# EasyEDA Pro project rckid3_devboard.eprj, board RCKid (continued)
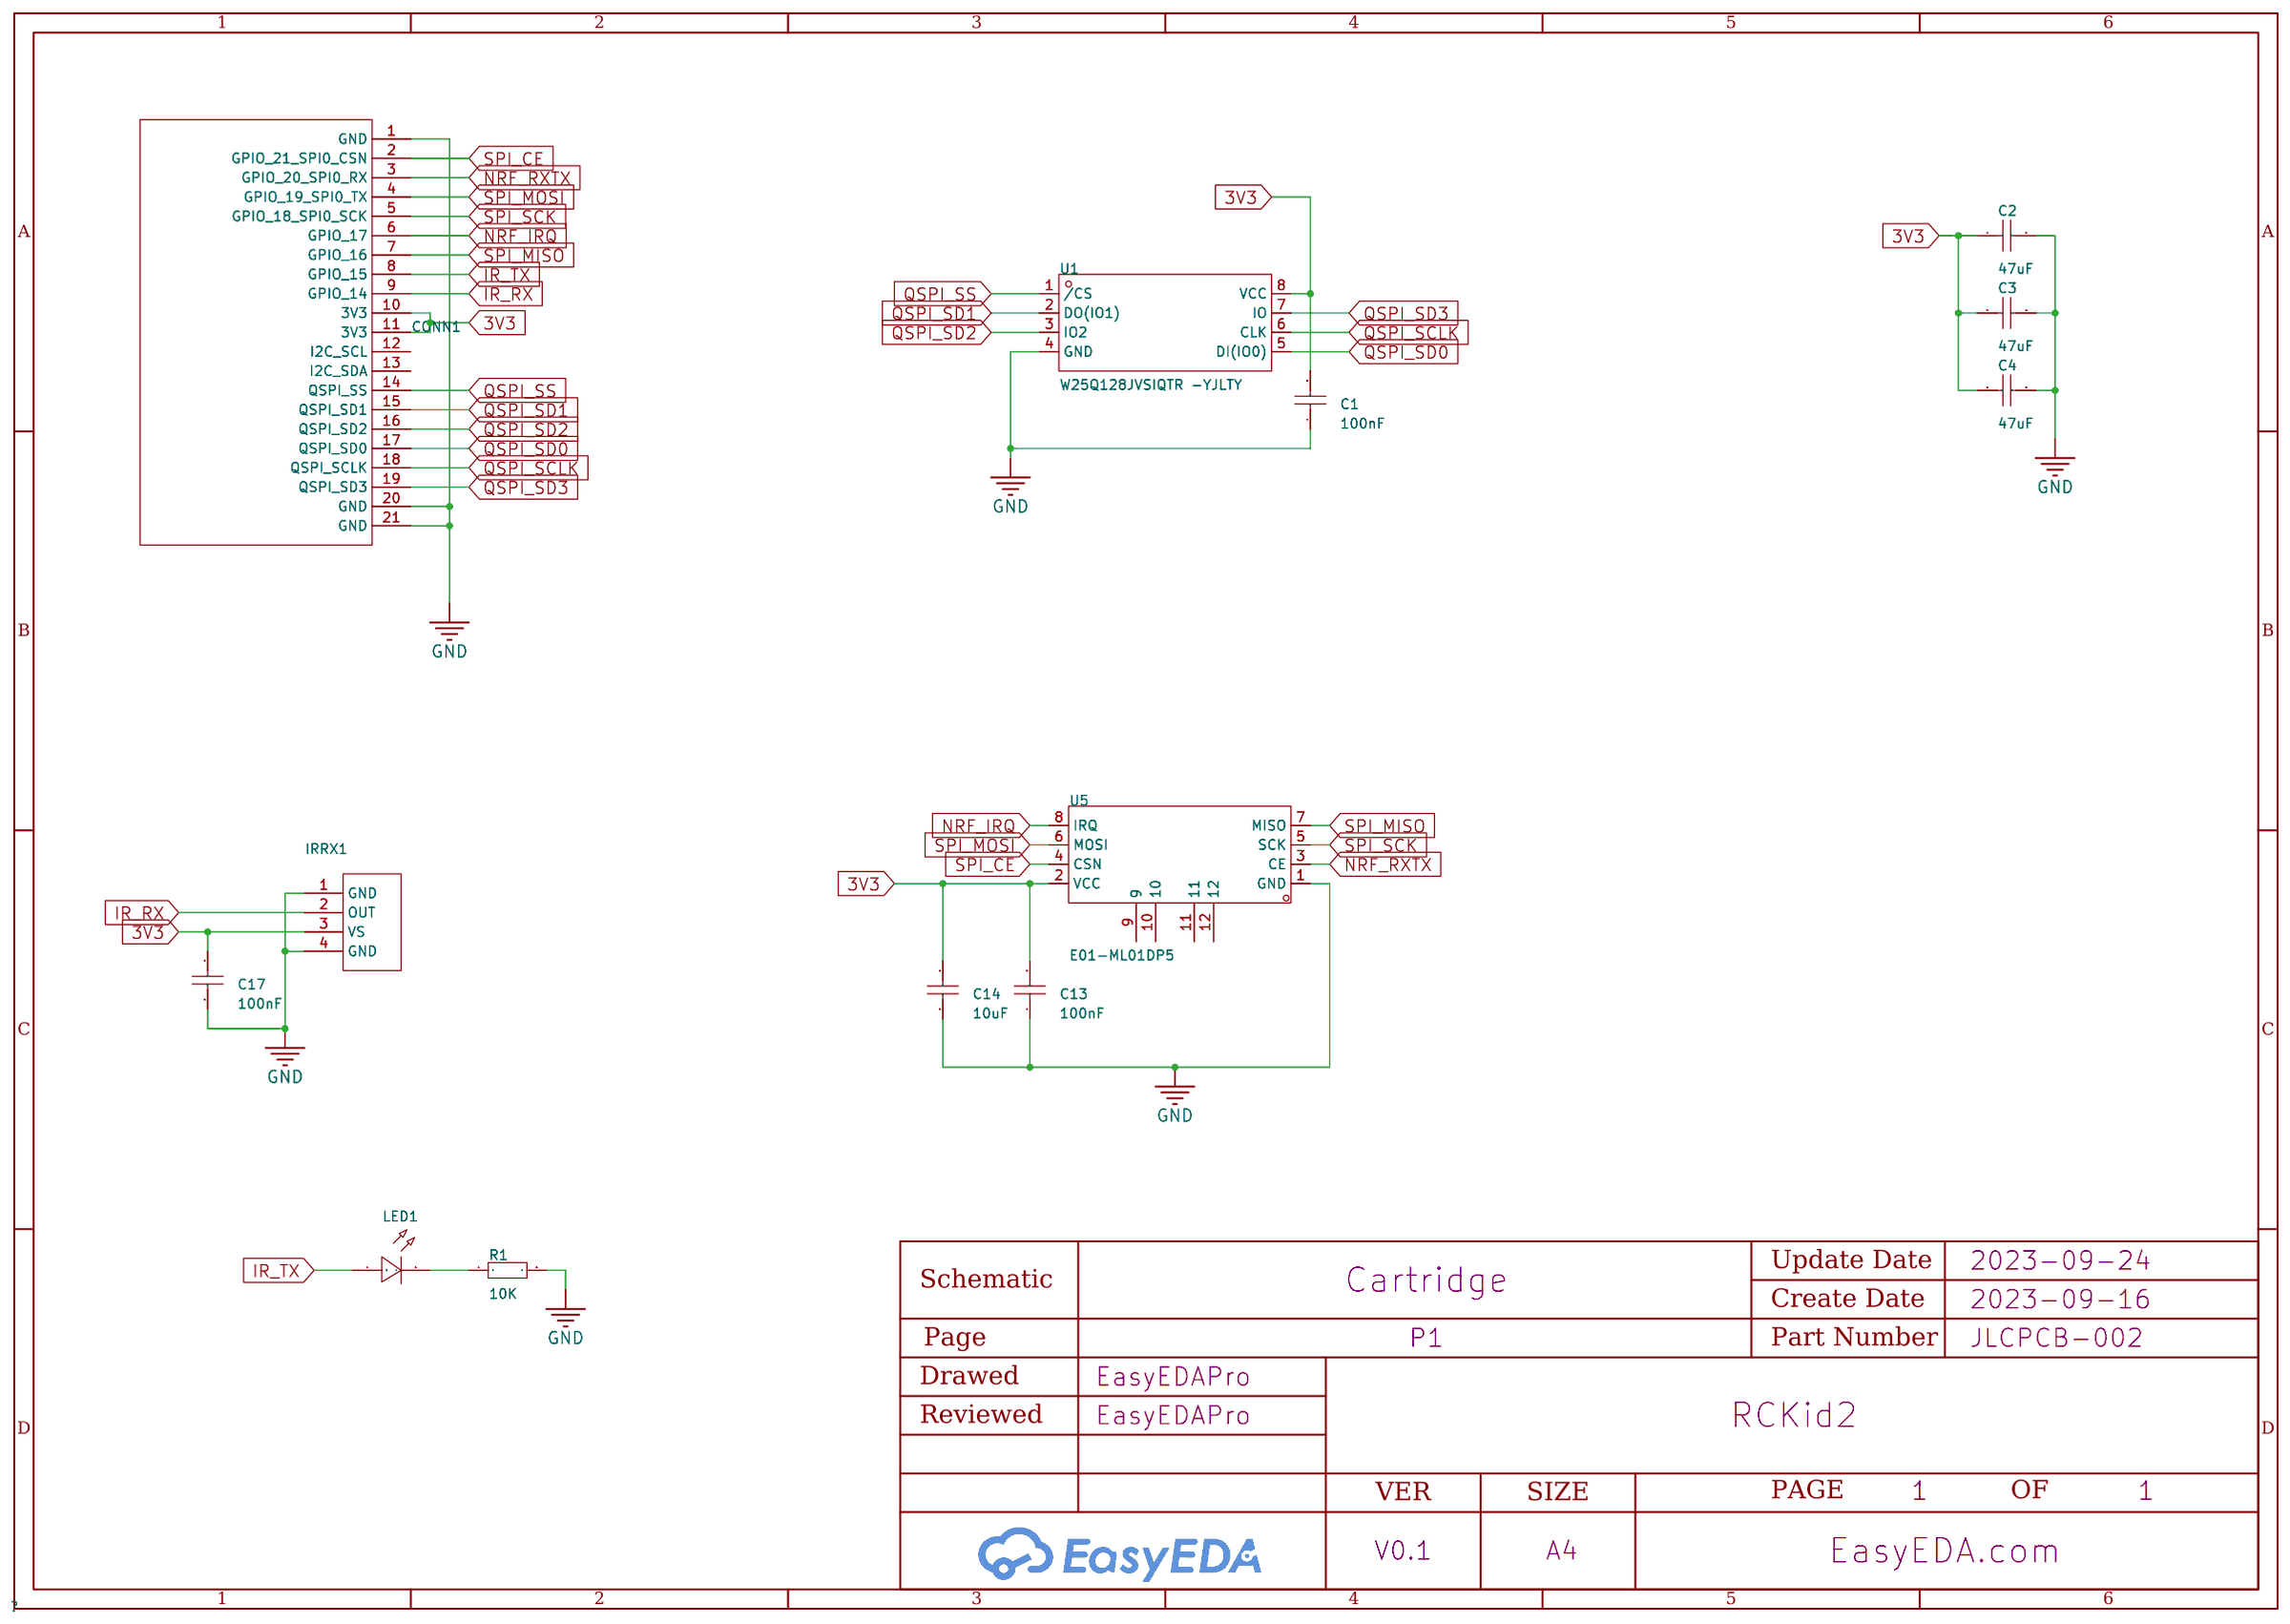
[diagram p0: NRF24L01P]
## Routing (per net, layer and track width the routed paths; a pad name or vN(x,y) marks a point on that pad's centre or on a via; arc(x,y) is an arc through that point) (continued)
  Bottom Layer w0.2: v1(82,57.19) HOME1.1
BTN_DPAD: length 44.7
  Top Layer w0.15: v1(41.4,49.29) 42,49.89 46.2,49.89 46.65,49.44 AVR.19 ; LEFT1.2 LEFT1.4
  Top Layer w0.2: LEFT1.4 32.7,46.44 34.65,44.49 BOTTOM1.2 BOTTOM1.4 34.65,38.49 32.7,36.54 RIGHT1.2 ; RIGHT1.4 26.7,36.54 24.75,38.49 TOP1.2 TOP1.4 24.75,44.49 26.7,46.44 LEFT1.2
  Bottom Layer w0.15: v1(41.4,49.29) 37.6,45.49 v1(33.7,45.49)
DB_0: length 60.7
  Top Layer w0.15: DISPLAY.24 59.77,82.79 58.8,82.79 46.5,95.09 37.5,95.09 35.6,96.99 25.6,96.99 23.2,94.59 23.2,87.99 21.3,86.09 21.3,82.56 22.27,81.59 RP2350B.44
DB_1: length 59.3
  Top Layer w0.15: DISPLAY.23 58.55,82.24 46.3,94.49 37.3,94.49 35.2,96.59 26,96.59 23.8,94.39 23.8,87.79 21.7,85.69 21.7,82.72 22.43,81.99 RP2350B.43
DB_2: length 57.9
  Top Layer w0.15: DISPLAY.22 58.25,81.74 46.1,93.89 37.1,93.89 34.8,96.19 26.4,96.19 24.4,94.19 24.4,87.59 22.1,85.29 22.1,82.89 22.6,82.39 RP2350B.42
DB_3: length 52.3
  Top Layer w0.15: RP2350B.40 26.4,84.39 25,85.79 25,93.99 26.8,95.79 34.4,95.79 36.9,93.29 45.9,93.29 57.95,81.24 DISPLAY.21
DB_4: length 51.3
  Top Layer w0.15: DISPLAY.20 57.65,80.74 45.7,92.69 36.7,92.69 34,95.39 27.2,95.39 25.6,93.79 25.6,85.76 26.8,84.56 RP2350B.39
DB_5: length 50.4
  Top Layer w0.15: RP2350B.38 27.2,84.72 26.2,85.72 26.2,93.59 27.6,94.99 33.6,94.99 36.5,92.09 45.5,92.09 57.35,80.24 DISPLAY.19
DB_6: length 49.5
  Top Layer w0.15: RP2350B.37 27.6,84.89 26.8,85.69 26.8,93.39 28,94.59 33.2,94.59 36.3,91.49 45.3,91.49 57.05,79.74 DISPLAY.18
DB_7: length 48.6
  Top Layer w0.15: DISPLAY.17 56.75,79.24 45.2,90.79 36.2,90.79 32.8,94.19 28.4,94.19 27.4,93.19 27.4,85.65 28,85.05 RP2350B.36
DB_8: length 37.3
  Top Layer w0.15: RP2350B.28 31.2,85.69 32.3,86.79 32.3,87.39 35,90.09 45.1,90.09 56.45,78.74 DISPLAY.16
DB_9: length 36.5
  Top Layer w0.15: RP2350B.27 31.6,85.49 32.7,86.59 32.7,87.19 35,89.49 44.9,89.49 56.15,78.24 DISPLAY.15
DB_10: length 35.7
  Top Layer w0.15: RP2350B.26 32,85.29 33.1,86.39 33.1,87.02 34.97,88.89 44.7,88.89 55.85,77.74 DISPLAY.14
DB_11: length 34.9
  Top Layer w0.15: RP2350B.25 32.4,85.09 33.5,86.19 33.5,86.86 34.93,88.29 44.5,88.29 55.55,77.24 DISPLAY.13
DB_12: length 33.2
  Top Layer w0.15: RP2350B.23 33.2,84.69 34.1,85.59 36.42,85.59 38.52,87.69 44.3,87.69 55.25,76.74 DISPLAY.12
DB_13: length 32.4
  Top Layer w0.15: DISPLAY.11 54.95,76.24 44.1,87.09 38.49,87.09 36.59,85.19 34.3,85.19 33.6,84.49 RP2350B.22
DB_14: length 31.6
  Top Layer w0.15: DISPLAY.10 54.65,75.74 43.9,86.49 38.45,86.49 36.75,84.79 34.5,84.79 34,84.29 RP2350B.21
DB_15: length 30.3
  Top Layer w0.15: RP2350B.20 35.6,82.79 38.6,85.79 43.8,85.79 54.35,75.24 DISPLAY.9
DISP_CSX: length 65.7
  Top Layer w0.15: RP2350B.48 21.37,79.99 19.7,81.66 19.7,87.69 20.8,88.79 20.8,95.39 24,98.59 37.2,98.59 38.3,97.49 47.3,97.49 58.05,86.74 DISPLAY.32
DISP_DCX: length 64.3
  Top Layer w0.15: RP2350B.47 21.53,80.39 20.1,81.82 20.1,87.29 21.4,88.59 21.4,95.19 24.4,98.19 36.8,98.19 38.1,96.89 47.1,96.89 57.75,86.24 DISPLAY.31
DISP_LED_K: length 8.3
  Top Layer w0.3: DISPLAY.6 62.42,73.74 ; 62.42,73.74 R84.1 62.02,74.24 DISPLAY.7 ; 62.42,73.74 61.92,73.24 DISPLAY.5
DISP_RDX: length 61.4
  Top Layer w0.15: RP2350B.45 22,81.19 20.9,82.29 20.9,86.49 22.6,88.19 22.6,94.79 25.2,97.39 36,97.39 37.7,95.69 46.7,95.69 57.15,85.24 DISPLAY.29
DISP_TE: length 67.2
  Top Layer w0.15: DISPLAY.33 58.35,87.24 47.5,98.09 38.5,98.09 37.6,98.99 23.6,98.99 20.2,95.59 20.2,88.99 19.3,88.09 19.3,81.49 21.2,79.59 RP2350B.49
DISP_WRX: length 62.9
  Top Layer w0.15: RP2350B.46 21.7,80.79 20.5,81.99 20.5,86.89 22,88.39 22,94.99 24.8,97.79 36.4,97.79 37.9,96.29 46.9,96.29 57.45,85.74 DISPLAY.30
EMBEDDED_ANTENNA: length 22.4
  Top Layer w0.25: v1(73.4,15.79) 73.52,15.91 RADIO.4 ; FMA.1 61.7,3.87 L19.1 61.93,6.42 v1(63,7.49)
  Bottom Layer w0.25: v1(63,7.49) 64.3,7.49 65.1,8.29 65.1,13.89 67,15.79 v1(73.4,15.79)
GPIO_11: length 53.8
  Top Layer w0.15: CARTRIDGE.9 54.69,61.48 arc(54.48,61.57) 54.27,61.48 54.15,61.36 arc(53.73,61.36) 53.73,61.79 54.74,62.81 arc(54.74,63.23) 54.32,63.23 53.3,62.21 arc(52.88,62.21) 52.88,62.64 53.79,63.55 arc(53.79,63.98) 53.37,63.98 52.1,62.71 arc(51.68,62.71) 51.68,63.14 52.15,63.6 arc(52.23,63.82) 52.15,64.03 51.88,64.29 51.55,64.29 arc(51.34,64.2) 51.25,63.99 51.25,63.79 arc(50.95,63.49) 50.65,63.79 50.65,63.99 arc(50.56,64.2) 50.35,64.29 49.5,64.29 44.1,69.69 44.1,69.99 arc(44.01,70.2) 43.8,70.29 43.6,70.29 arc(43.3,70.59) 43.6,70.89 43.9,70.89 arc(44.2,71.19) 43.9,71.49 43,71.49 arc(42.7,71.79) 43,72.09 43.9,72.09 arc(44.2,72.39) 43.9,72.69 43,72.69 arc(42.7,72.99) 43,73.29 43.9,73.29 arc(44.2,73.59) 43.9,73.89 43,73.89 arc(42.7,74.19) 43,74.49 43.8,74.49 arc(44.01,74.58) 44.1,74.79 44.1,75.19 43.95,75.34 arc(43.73,75.43) 43.52,75.34 43.2,75.02 arc(42.77,75.02) 42.77,75.44 43.1,75.77 arc(43.1,76.19) 42.67,76.19 42.35,75.87 arc(41.92,75.87) 41.92,76.29 42.25,76.62 arc(42.25,77.04) 41.82,77.04 41.5,76.72 arc(41.07,76.72) 41.07,77.14 41.4,77.47 arc(41.49,77.68) 41.4,77.89 41.2,78.09 37.3,78.09 37,78.39 RP2350B.9
GPIO_12: length 53.8
  Top Layer w0.15: CARTRIDGE.8 57.21,61.5 arc(57.12,61.71) 57.21,61.93 57.63,62.34 arc(57.63,62.76) 57.2,62.76 56.44,62 arc(56.01,62) 56.01,62.42 56.78,63.19 arc(56.78,63.61) 56.35,63.61 55.94,63.2 arc(55.51,63.2) 55.51,63.62 55.93,64.04 arc(55.93,64.46) 55.5,64.46 55.09,64.05 arc(54.88,63.96) 54.67,64.05 53.92,64.79 49.9,64.79 46,68.69 46,68.99 arc(45.91,69.2) 45.7,69.29 45.4,69.29 arc(45.1,69.59) 45.4,69.89 45.7,69.89 arc(46,70.19) 45.7,70.49 45.2,70.49 arc(44.9,70.79) 45.2,71.09 45.7,71.09 arc(46,71.39) 45.7,71.69 45.1,71.69 arc(44.8,71.99) 45.1,72.29 45.7,72.29 arc(46,72.59) 45.7,72.89 45.1,72.89 arc(44.8,73.19) 45.1,73.49 45.7,73.49 arc(46,73.79) 45.7,74.09 45.1,74.09 arc(44.8,74.39) 45.1,74.69 45.7,74.69 arc(45.91,74.78) 46,74.99 46,75.59 45.25,76.34 arc(45.03,76.43) 44.82,76.34 44.55,76.07 arc(44.12,76.07) 44.12,76.49 44.4,76.77 arc(44.4,77.19) 43.97,77.19 43.7,76.92 arc(43.27,76.92) 43.27,77.34 43.55,77.62 arc(43.55,78.04) 43.12,78.04 42.85,77.77 arc(42.42,77.77) 42.42,78.19 42.7,78.47 arc(42.79,78.68) 42.7,78.89 42.4,79.19 RP2350B.11
GPIO_13: length 53.8
  Top Layer w0.15: CARTRIDGE.7 59.73,61.52 arc(59.64,61.73) 59.73,61.95 60.08,62.29 arc(60.08,62.71) 59.65,62.71 58.96,62.02 arc(58.53,62.02) 58.53,62.44 59.23,63.14 arc(59.23,63.56) 58.8,63.56 58.46,63.22 arc(58.03,63.22) 58.03,63.64 58.38,63.99 arc(58.38,64.41) 57.95,64.41 57.61,64.07 arc(57.19,64.07) 57.19,64.49 57.53,64.84 arc(57.53,65.26) 57.11,65.26 56.76,64.92 arc(56.55,64.83) 56.34,64.92 55.96,65.29 50.3,65.29 47.9,67.69 47.9,68.19 arc(47.81,68.4) 47.6,68.49 47.2,68.49 arc(46.9,68.79) 47.2,69.09 47.6,69.09 arc(47.9,69.39) 47.6,69.69 47,69.69 arc(46.7,69.99) 47,70.29 47.6,70.29 arc(47.9,70.59) 47.6,70.89 47,70.89 arc(46.7,71.19) 47,71.49 47.6,71.49 arc(47.9,71.79) 47.6,72.09 47,72.09 arc(46.7,72.39) 47,72.69 47.6,72.69 arc(47.9,72.99) 47.6,73.29 47,73.29 arc(46.7,73.59) 47,73.89 47.6,73.89 arc(47.81,73.98) 47.9,74.19 47.9,74.59 42.6,79.89 42,79.89 41.7,79.59 RP2350B.12
GPIO_14: length 53.8
  Top Layer w0.15: RP2350B.13 41.2,79.99 41.8,80.59 42.8,80.59 49.4,73.99 49.4,73.69 arc(49.31,73.48) 49.1,73.39 48.9,73.39 arc(48.6,73.09) 48.9,72.79 49.1,72.79 arc(49.4,72.49) 49.1,72.19 48.9,72.19 arc(48.6,71.89) 48.9,71.59 49.1,71.59 arc(49.4,71.29) 49.1,70.99 48.9,70.99 arc(48.6,70.69) 48.9,70.39 49.1,70.39 arc(49.4,70.09) 49.1,69.79 48.9,69.79 arc(48.6,69.49) 48.9,69.19 49.1,69.19 arc(49.4,68.89) 49.1,68.59 48.9,68.59 arc(48.6,68.29) 48.9,67.99 49.1,67.99 arc(49.31,67.9) 49.4,67.69 49.4,67.09 50.7,65.79 58,65.79 58.06,65.73 arc(58.27,65.65) 58.48,65.73 58.51,65.76 arc(58.93,65.76) 58.93,65.33 58.91,65.31 arc(58.91,64.89) 59.33,64.89 59.71,65.26 arc(60.13,65.26) 60.13,64.84 59.76,64.46 arc(59.76,64.04) 60.18,64.04 60.55,64.41 arc(60.98,64.41) 60.98,63.99 60.6,63.61 arc(60.6,63.19) 61.03,63.19 61.4,63.56 arc(61.83,63.56) 61.83,63.14 61.25,62.56 arc(61.25,62.14) 61.68,62.14 62.25,62.71 arc(62.68,62.71) 62.68,62.29 62.3,61.92 arc(62.21,61.7) 62.3,61.49 CARTRIDGE.6
GPIO_15: length 53.8
  Top Layer w0.15: CARTRIDGE.5 64.82,61.51 arc(64.73,61.72) 64.82,61.94 65.23,62.34 arc(65.23,62.76) 64.8,62.76 64.4,62.36 arc(63.97,62.36) 63.97,62.78 64.38,63.19 arc(64.38,63.61) 63.95,63.61 63.55,63.21 arc(63.12,63.21) 63.12,63.63 63.53,64.04 arc(63.53,64.46) 63.1,64.46 62.7,64.06 arc(62.28,64.06) 62.28,64.48 62.68,64.89 arc(62.68,65.31) 62.26,65.31 61.85,64.91 arc(61.43,64.91) 61.43,65.33 61.83,65.73 arc(61.83,66.16) 61.41,66.16 61,65.75 arc(60.79,65.67) 60.58,65.75 60.04,66.29 51.3,66.29 50.4,67.19 50.4,67.99 arc(50.36,68.09) 50.25,68.14 arc(50.14,68.18) 50.1,68.29 50.1,68.59 arc(50.14,68.69) 50.25,68.74 arc(50.36,68.78) 50.4,68.89 50.4,69.19 arc(50.36,69.29) 50.25,69.34 arc(50.14,69.38) 50.1,69.49 50.1,69.79 arc(50.14,69.89) 50.25,69.94 arc(50.36,69.98) 50.4,70.09 50.4,70.39 arc(50.36,70.49) 50.25,70.54 arc(50.14,70.58) 50.1,70.69 50.1,70.99 arc(50.14,71.09) 50.25,71.14 arc(50.36,71.18) 50.4,71.29 50.4,71.59 arc(50.36,71.69) 50.25,71.74 arc(50.14,71.78) 50.1,71.89 50.1,72.19 arc(50.14,72.29) 50.25,72.34 arc(50.36,72.38) 50.4,72.49 50.4,72.79 arc(50.36,72.89) 50.25,72.94 arc(50.14,72.98) 50.1,73.09 50.1,73.39 arc(50.14,73.49) 50.25,73.54 arc(50.36,73.58) 50.4,73.69 50.4,73.89 43,81.29 41.6,81.29 40.7,80.39 RP2350B.14
GPIO_16: length 53.9
  Top Layer w0.15: CARTRIDGE.4 67.29,61.58 arc(67.2,61.79) 67.29,62.01 67.68,62.39 arc(67.68,62.81) 67.25,62.81 66.87,62.43 arc(66.44,62.43) 66.44,62.85 66.78,63.19 arc(66.78,63.61) 66.35,63.61 66.02,63.28 arc(65.59,63.28) 65.59,63.7 65.93,64.04 arc(65.93,64.46) 65.5,64.46 65.17,64.13 arc(64.75,64.13) 64.75,64.55 65.08,64.89 arc(65.08,65.31) 64.66,65.31 64.32,64.98 arc(63.9,64.98) 63.9,65.4 64.23,65.73 arc(64.23,66.16) 63.81,66.16 63.47,65.82 arc(63.05,65.82) 63.05,66.25 arc(63.05,66.67) 62.62,66.67 arc(62.41,66.58) 62.2,66.67 62.08,66.79 53.1,66.79 51.1,68.79 51.1,74.09 43.2,81.99 37.8,81.99 37,81.19 RP2350B.16
GPIO_17: length 53.6
  Top Layer w0.15: RP2350B.17 36.7,81.59 37.8,82.69 43.4,82.69 51.8,74.29 51.8,68.99 53.5,67.29 64.12,67.29 65.57,65.84 arc(65.78,65.76) 65.99,65.84 66.16,66.01 arc(66.58,66.01) 66.58,65.58 66.42,65.42 arc(66.42,65) 66.84,65 67.01,65.16 arc(67.43,65.16) 67.43,64.74 67.27,64.57 arc(67.27,64.15) 67.69,64.15 67.85,64.31 arc(68.28,64.31) 68.28,63.89 68.11,63.72 arc(68.11,63.3) 68.54,63.3 68.7,63.46 arc(69.13,63.46) 69.13,63.04 68.96,62.87 arc(68.96,62.45) 69.39,62.45 69.55,62.61 arc(69.98,62.61) 69.98,62.19 69.81,62.03 arc(69.72,61.81) 69.81,61.6 CARTRIDGE.3
GPIO_18: length 53.7
  Top Layer w0.15: RP2350B.18 36.4,81.99 37.8,83.39 43.6,83.39 52.5,74.49 52.5,69.19 53.9,67.79 66.16,67.79 70.36,63.59 arc(70.58,63.5) 70.79,63.59 71.03,63.83 arc(71.46,63.83) 71.46,63.41 71.21,63.16 arc(71.21,62.74) 71.64,62.74 71.93,63.03 arc(72.36,63.03) 72.36,62.61 72.06,62.31 arc(71.97,62.1) 72.06,61.89 CARTRIDGE.2
GPIO_19: length 53.8
  Top Layer w0.15: CARTRIDGE.1 75.3,60.99 68,68.29 54.3,68.29 53.2,69.39 53.2,74.69 43.8,84.09 37.8,84.09 36.1,82.39 RP2350B.19
GPIO_47: length 16.2
  Top Layer w0.15: RP2350B.58 24.8,75.99 23.94,75.13 v1(23.94,75.09)
  Bottom Layer w0.15: CARTRIDGE.21 24.7,64.39 23.94,65.15 v1(23.94,75.09)
HEADSET_ANTENNA: length 8.7
  Top Layer w0.25: RADIO.2 72.52,15.37 73,14.89 75.3,14.89 76.2,13.99 C242.2
HEADSET_DETECT: length 47.1
  Top Layer w0.15: 70.9,32.62 70.9,33.09 v1(71.3,33.49) ; v1(65.6,15.69) 67.5,17.59 67.5,20.99 v1(69.2,22.69) ; 76.7,29.05 75.95,29.05 v1(75.9,29.09) ; AUDIO.8 73.82,36.89 v1(72.4,36.89)
  Top Layer w0.2: v1(64.2,9.19) 64.2,6.09 HEADSET.2
  Bottom Layer w0.15: v1(72.4,36.89) 71.3,35.79 v1(71.3,33.49) 72.7,32.09 75.4,32.09 75.9,31.59 v1(75.9,29.09) 75.9,27.95 74.54,26.59 70.7,26.59 69.2,25.09 v1(69.2,22.69)
  Bottom Layer w0.2: v1(64.2,9.19) 64.2,14.29 v1(65.6,15.69)
HEADSET_LEFT: length 33.3
  Top Layer w0.25: v1(78.7,32.19) 78.15,32.74 AUDIO.25 ; v1(64.9,16.49) 63.7,16.49 62.7,15.49 C199.2
  Bottom Layer w0.25: v1(64.9,16.49) 76.7,16.49 78.2,17.99 78.2,30.69 78.7,31.19 v1(78.7,32.19)
HEADSET_MIC: length 2.1
  Top Layer w0.15: AUDIO.21 75.85,31.14 76.55,30.44 76.7,30.44
HEADSET_RIGHT: length 27.8
  Top Layer w0.25: AUDIO.27 78.85,33.74 v1(78.9,33.69) ; C200.2 80.3,7.5 v1(80.3,9.39)
  Bottom Layer w0.25: v1(78.9,33.69) 79.4,33.19 79.4,30.28 79.24,30.12 79.24,10.45 v1(80.3,9.39)
I2C_SCL: length 61.7
  Top Layer w0.15: v1(42.97,41.53) 42.1,40.66 42.1,39.59 42.5,39.19 U26.13 ; v1(47.2,52.49) 47.83,52.49 U41.4 48.15,52.54 48.75,51.94 48.75,50.22 ; U40.2 42.35,52.94 v1(42.6,52.69) ; PWR.5 27.45,18.54 v1(27.7,18.29) ; R45.1 44.2,45.42 v1(44.2,46.29) v1(43,46.29)
  Bottom Layer w0.15: v1(27.7,18.29) 29.5,18.29 32.68,21.47 TP7.1 33.8,22.49 33.8,23.69 43,32.89 v1(43,46.29) 43,52.29 v1(42.6,52.69) ; v1(44.2,46.29) 44.2,50.79 45.9,52.49 v1(47.2,52.49)
I2C_SCL_VDD: length 106.2
  Top Layer w0.15: RP2350B.78 33.2,73.19 33.6,72.79 34.3,72.79 37,70.09 37,68.79 41.3,64.49 41.3,58.39 v1(42.2,57.49) 43.3,56.39 45.5,56.39 46.6,55.29 49.4,55.29 49.8,54.89 62.8,54.89 65.1,52.59 65.1,41.09 v1(65.8,40.39) ; AUDIO.9 71.95,36.24 v1(70.8,37.39) v1(69.9,36.49) ; RADIO.7 76.24,17.35 v1(76.4,17.19) ; 41.2,51.49 U40.10
  Bottom Layer w0.15: v1(76.4,17.19) 76.3,17.09 70.1,17.09 66.5,20.69 66.5,33.09 v1(69.9,36.49) ; v1(42.2,57.49) 41.3,56.59 41.3,51.59 v1(41.2,51.49) ; v1(70.8,37.39) 69.4,38.79 67.4,38.79 v1(65.8,40.39)
I2C_SDA: length 60.9
  Top Layer w0.15: PWR.6 27.95,19.24 28.6,18.59 v1(28.6,17.69) ; v1(47.2,53.79) 47.83,53.79 U41.6 48.45,53.84 49.25,53.04 49.25,50.22 ; U26.14 43,38.69 42.9,38.59 42.9,37.29 v1(43.6,36.59) ; U40.4 42.05,53.94 42.5,54.39 v1(42.6,54.39) ; v1(43.6,43.29) 43.9,43.29 44.23,43.62 R46.1
  Bottom Layer w0.15: 43.6,53.39 v1(42.6,54.39) ; 43.6,53.39 44,53.79 v1(47.2,53.79) ; 43.6,53.39 v1(43.6,43.29) v1(43.6,36.59) 43.6,32.59 35,23.99 35,21.39 33.4,19.79 31.9,19.79 29.8,17.69 v1(28.6,17.69)
I2C_SDA_VDD: length 101.1
  Top Layer w0.15: 41.3,55.69 45.3,55.69 46.3,54.69 49.1,54.69 49.5,54.29 62.5,54.29 64.5,52.29 64.5,40.79 v1(65.1,40.19) ; 41.3,55.69 40.6,56.39 40.6,58.09 41,58.49 41,64.19 36.5,68.69 36.5,69.99 34.2,72.29 33.4,72.29 32.8,72.89 RP2350B.77 ; 41.3,55.69 40.56,54.95 U40.6 40.6,53.98 ; v1(76.4,18.09) 76.16,17.85 RADIO.8 ; v1(70.8,36.49) 71.55,35.74 AUDIO.10
  Bottom Layer w0.15: v1(65.1,40.19) 67.1,38.19 69.1,38.19 v1(70.8,36.49) 67.1,32.79 67.1,20.99 70,18.09 v1(76.4,18.09)
I2S_BCK: length 70.3
  Top Layer w0.15: RP2350B.7 36.6,77.59 37.4,76.79 39.4,76.79 41.5,74.69 41.5,70.49 48.9,63.09 49.5,63.09 51.1,61.49 51.1,59.89 51.9,59.09 65,59.09 69.3,54.79 69.3,43.19 70.2,42.29 74.1,42.29 76.85,39.54 AUDIO.2
I2S_DIN: length 67.3
  Top Layer w0.15: RP2350B.4 36,76.39 40.3,72.09 40.3,69.89 48.6,61.59 48.6,59.69 50,58.29 50.9,58.29 51.3,57.89 64.3,57.89 68.1,54.09 68.1,42.59 69.6,41.09 73.5,41.09 75.85,38.74 AUDIO.4
I2S_DOUT: length 67.7
  Top Layer w0.15: AUDIO.5 75.35,38.34 73.2,40.49 69.3,40.49 67.5,42.29 67.5,53.79 64,57.29 51,57.29 50.6,57.69 47.8,57.69 46.5,58.99 46.5,62.79 39.7,69.59 39.7,71.89 36.5,75.09 36.5,75.39 35.9,75.99 RP2350B.3
I2S_LRCK: length 69.7
  Top Layer w0.15: RP2350B.6 36.4,77.19 37.4,76.19 39.3,76.19 40.9,74.59 40.9,70.19 49.1,61.99 49.1,60.09 50.3,58.89 51.2,58.89 51.6,58.49 64.7,58.49 68.7,54.49 68.7,42.89 69.9,41.69 73.8,41.69 76.35,39.14 AUDIO.3
IOVDD: length 66.9
  Top Layer w0.15: 54.9,36.39 v1(56.5,36.39) ; 54.8,36.39 54.8,35.29 54.9,35.19 ; R76.1 v1(65,87.59)
  Top Layer w0.2: C108.2 33.6,71.69 33.3,71.69 32.4,72.59 RP2350B.76 ; RP2350B.60 24.9,75.19 24.3,74.59 22.14,74.59 C116.2 ; RP2350B.24 32.8,84.89 34.36,86.45 34.36,86.49 ; RP2350B.69 29.6,71.89 29.4,71.69 ; 38.41,75.28 38.1,75.59 37.4,75.59 36.2,76.79 RP2350B.5 ; RP2350B.68 29.2,71.89 29.4,71.69 ; 31.2,87.15 31.2,86.39 30.8,85.99 RP2350B.29 ; C110.2 22.14,79.19 RP2350B.50 ; C111.2 23.45,82.79 RP2350B.41 ; 29.4,71.69 C167.2 ; RP2350B.15 37.4,80.79 37.8,81.19 C112.2
  Top Layer w0.25: v1(82.2,22.29) 81.4,23.09 81.4,23.59 80.9,24.09 ; 74.64,22.39 C237.1 74.72,22.41 74.72,22.39 ; 74.64,22.39 74.45,22.39 ; 74.64,22.39 74.72,22.39 ; C192.2 C204.1 ; C192.2 C191.2 80.05,33.09 78.7,33.09 78.55,33.24 AUDIO.26 ; C192.2 v1(81.1,32.19) ; RADIO.11 74.52,20.11 74.7,20.29 74.7,21.14 74.7,21.14 ; 74.7,21.14 74.64,21.19 C236.2 74.7,21.14 ; 74.7,21.14 74.72,21.17 v1(74.72,21.81) 74.72,22.39 ; v1(73.4,39.29) 73.4,38.54 C209.2 74.1,38.49 74.85,37.74 AUDIO.6 ; 74.72,22.39 75.2,22.39 75.6,21.99 75.6,19.29 75.16,18.85 RADIO.10 ; v1(79.2,35.49) 78.95,35.24 AUDIO.30
  Top Layer w0.4: microSD.4 67.7,90.99 67.3,90.59 C132.2
  Top Layer w0.5: 50.5,29.39 50.5,31.89 51.9,31.89 52.3,32.29 v1(52.3,32.79) v1(52.3,33.49) ; C132.2 v1(65,90.59)
  vias: v1(40,57.69) v1(56.7,42.39) v1(56.7,41.69) v1(56.7,40.99) v1(57.4,42.39) v1(57.4,41.69) v1(57.4,40.99)
